# EasyEDA Pro project C108_STM32.eprj, schematic Schematic8
Board Name: 运输车_上层; Create Date: 2025-01-17; Page Name: P1; Project Name: C108_STM32; Schematic Name: Schematic8; Update Date: 2025-01-25; Company: 嘉立创EDA; Page Size: A4; Version: V1.0
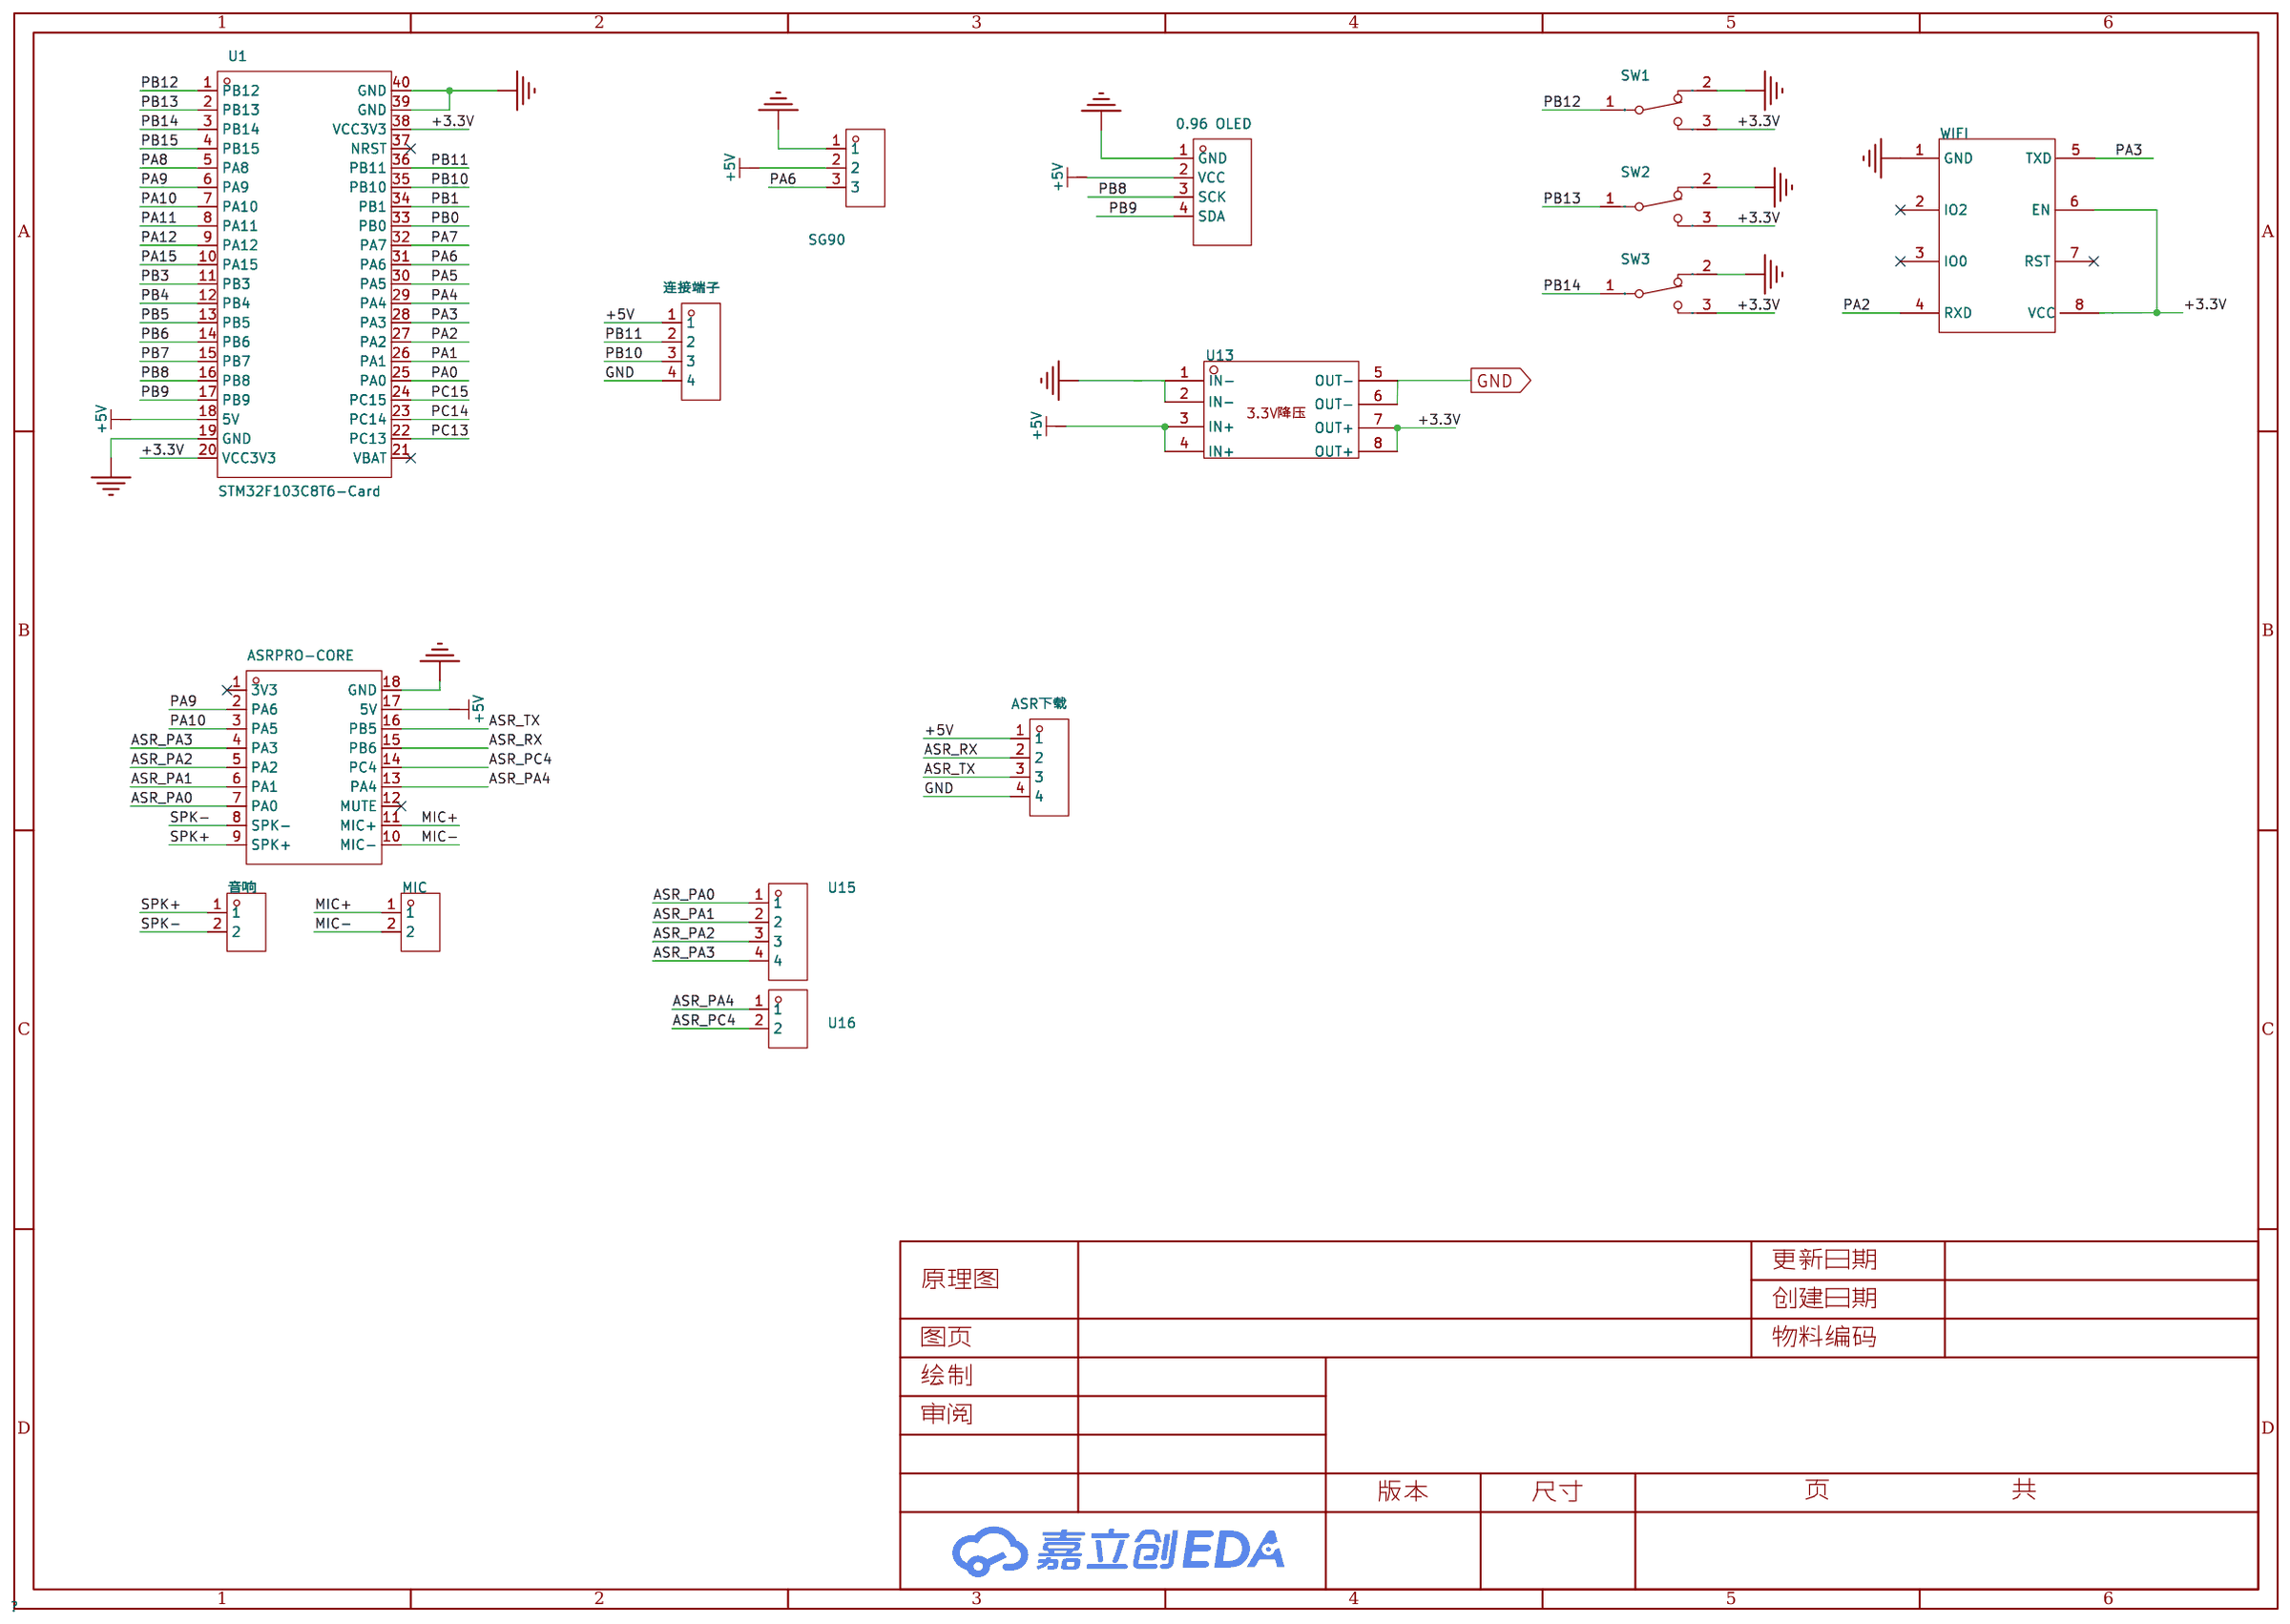
[diagram p7: schematic sheet]

## Parts
ASR下载  2.54*4单排  [HDR-TH_4P-P2.54-V-M-1]
MIC  单排2.54*2  [HDR-TH_2P-P2.54-V-M-1]
OLED1  0.96 OLED  [HDR-TH_4P-P2.54-V-M-1]
SG90  2.54*3单排  [HDR-TH_3P-P2.54-V-M-1]
SW1  TC-5610B-Y  [SW-TH_TC-5610B-Y]
SW2  TC-5610B-Y  [SW-TH_TC-5610B-Y]
SW3  TC-5610B-Y  [SW-TH_TC-5610B-Y]
U1  STM32F103C8T6-Card  [CONN-TH_L53.3-W22.9_STM32F103C8T6-CARD]
U13  -  [3.3V降压]
U14  ASRPRO-CORE  [COMM-SMD_ASRPRO-CORE-V1.1]
U15  2.54*4单排  [HDR-TH_4P-P2.54-V-M-1]
U16  单排2.54*2  [HDR-TH_2P-P2.54-V-M-1]
WIFI  -  [ESP-01]
连接端子  2.54*4单排  [HDR-TH_4P-P2.54-V-M-1]
音响  单排2.54*2  [HDR-TH_2P-P2.54-V-M-1]

## Library data of the parts
ASR下载 OLED1 U15 连接端子 = 2.54*4单排: Supplier Part: C9900016163; Supplier Footprint: 2.54x4; JLCPCB Part Class: 扩展库; Supplier: LCSC
MIC U16 音响 = 单排2.54*2: Supplier Part: C9900016158; Supplier Footprint: 2.54x2; JLCPCB Part Class: 扩展库; Supplier: LCSC
SG90 = 2.54*3单排: Supplier Part: C9900016162; Supplier Footprint: 2.54x3; JLCPCB Part Class: 扩展库; Supplier: LCSC
SW1-SW3 = 微动开关: LCSC Part Name: 微动开关/行程开关小微动12.7*5.6mm直柄; Supplier Part: C504858; Manufacturer: Yuandi(元迪); Supplier Footprint: 插件,5.6x12.7mm; JLCPCB Part Class: 扩展库; Datasheet: https://atta.szlcsc.com/upload/public/pdf/source/20200402/C504858_559638C7EF5AF0D5E07EFA2A56E7BD8D.pdf; Supplier: LCSC
U1 = STM32F103C8T6-Card: Supplier Part: C9900077949; Supplier Footprint: 插件; Supplier: LCSC
U13 = 3.3V降压
U14 = ASRPRO-CORE: Supplier Part: C9900058401; Supplier Footprint: SMD-18P; JLCPCB Part Class: 扩展库; Supplier: LCSC
WIFI = ESP-01

## Nets
+3.3V: SW1.3(NO) SW2.3(NO) SW3.3(NO) U1.20(VCC3V3) U1.38(VCC3V3) U13.7(OUT+) U13.8(OUT+) WIFI.6(EN) WIFI.8(VCC)
+5V: ASR下载.1 OLED1.2(VCC) SG90.2 U1.18(5V) U13.3(IN+) U13.4(IN+) U14.17(5V) 连接端子.1
GND: ASR下载.4 OLED1.1(GND) SG90.1 SW1.2(NC) SW2.2(NC) SW3.2(NC) U1.19(GND) U1.39(GND) U1.40(GND) U13.2(IN-) U13.6(OUT-) U14.18(GND) WIFI.1(GND) 连接端子.4
ASR_PA0: U14.7(PA0) U15.1
ASR_PA1: U14.6(PA1) U15.2
ASR_PA2: U14.5(PA2) U15.3
ASR_PA3: U14.4(PA3) U15.4
ASR_PA4: U14.13(PA4) U16.1
ASR_PC4: U14.14(PC4) U16.2
ASR_RX: ASR下载.2 U14.15(PB6)
ASR_TX: ASR下载.3 U14.16(PB5)
MIC+: MIC.1 U14.11(MIC+)
MIC-: MIC.2 U14.10(MIC-)
PA0: U1.25(PA0)
PA1: U1.26(PA1)
PA2: U1.27(PA2) WIFI.4(RXD)
PA3: U1.28(PA3) WIFI.5(TXD)
PA4: U1.29(PA4)
PA5: U1.30(PA5)
PA6: SG90.3 U1.31(PA6)
PA7: U1.32(PA7)
PA8: U1.5(PA8)
PA9: U1.6(PA9) U14.2(PA6)
PA10: U1.7(PA10) U14.3(PA5)
PA11: U1.8(PA11)
PA12: U1.9(PA12)
PA15: U1.10(PA15)
PB0: U1.33(PB0)
PB1: U1.34(PB1)
PB3: U1.11(PB3)
PB4: U1.12(PB4)
PB5: U1.13(PB5)
PB6: U1.14(PB6)
PB7: U1.15(PB7)
PB8: OLED1.3(SCK) U1.16(PB8)
PB9: OLED1.4(SDA) U1.17(PB9)
PB10: U1.35(PB10) 连接端子.3
PB11: U1.36(PB11) 连接端子.2
PB12: SW1.1(COM) U1.1(PB12)
PB13: SW2.1(COM) U1.2(PB13)
PB14: SW3.1(COM) U1.3(PB14)
PB15: U1.4(PB15)
PC13: U1.22(PC13)
PC14: U1.23(PC14)
PC15: U1.24(PC15)
SPK+: U14.9(SPK+) 音响.1
SPK-: U14.8(SPK-) 音响.2

Not connected (* = marked no-connect by the designer): U1 21(VBAT)* 37(NRST)*; U13 1(IN-) 5(OUT-); U14 1(3V3)* 12(MUTE)*; WIFI 2(IO2)* 3(IO0)* 7(RST)*
